# Altium schematic sheet transmitter.SchDoc (continued)
## Nets
5V: J1.5(5V) J1.6(3V3) J2.5(5V) J2.6(3V3) J3.5(5V) J3.6(3V3) J4.5(5V) J4.6(3V3) J5.5(5V) J5.6(3V3) J6.5(5V) J6.6(3V3) J7.5(5V) J7.6(3V3) J8.5(5V) J8.6(3V3)
GND: C1.1 C2.1 C3.1 C4.1 C5.1 C6.1 C7.1 C8.1 J1.3(GND) J1.4(GND) J1.97(GND) J1.98(GND) J2.3(GND) J2.4(GND) J2.97(GND) J2.98(GND) J3.3(GND) J3.4(GND) J3.97(GND) J3.98(GND) J4.3(GND) J4.4(GND) J4.97(GND) J4.98(GND) J5.3(GND) J5.4(GND) J5.97(GND) J5.98(GND) J6.3(GND) J6.4(GND) J6.97(GND) J6.98(GND) J7.3(GND) J7.4(GND) J7.97(GND) J7.98(GND) J8.3(GND) J8.4(GND) J8.97(GND) J8.98(GND)
VUS: C1.2 C2.2 C3.2 C4.2 C5.2 C6.2 C7.2 C8.2 J1.1(VUS) J1.2(VUS) J1.99(VUS) J1.100(VUS) J2.1(VUS) J2.2(VUS) J2.99(VUS) J2.100(VUS) J3.1(VUS) J3.2(VUS) J3.99(VUS) J3.100(VUS) J4.1(VUS) J4.2(VUS) J4.99(VUS) J4.100(VUS) J5.1(VUS) J5.2(VUS) J5.99(VUS) J5.100(VUS) J6.1(VUS) J6.2(VUS) J6.99(VUS) J6.100(VUS) J7.1(VUS) J7.2(VUS) J7.99(VUS) J7.100(VUS) J8.1(VUS) J8.2(VUS) J8.99(VUS) J8.100(VUS)
NetJ1_7: J1.7(US_N) ; sheet U_ultra/US_N
NetJ1_8: J1.8(US_P) ; sheet U_ultra/US_P
NetJ1_9: J1.9(US_N) ; sheet U_ultra/US_N
NetJ1_10: J1.10(US_P) ; sheet U_ultra/US_P
NetJ1_11: J1.11(US_N) ; sheet U_ultra/US_N
NetJ1_12: J1.12(US_P) ; sheet U_ultra/US_P
NetJ1_13: J1.13(US_N) ; sheet U_ultra/US_N
NetJ1_14: J1.14(US_P) ; sheet U_ultra/US_P
NetJ1_15: J1.15(US_N) ; sheet U_ultra/US_N
NetJ1_16: J1.16(US_P) ; sheet U_ultra/US_P
NetJ1_17: J1.17(US_N) ; sheet U_ultra/US_N
NetJ1_18: J1.18(US_P) ; sheet U_ultra/US_P
NetJ1_19: J1.19(US_N) ; sheet U_ultra/US_N
NetJ1_20: J1.20(US_P) ; sheet U_ultra/US_P
NetJ1_21: J1.21(US_N) ; sheet U_ultra/US_N
NetJ1_22: J1.22(US_P) ; sheet U_ultra/US_P
NetJ1_23: J1.23(US_N) ; sheet U_ultra/US_N
NetJ1_24: J1.24(US_P) ; sheet U_ultra/US_P
NetJ1_25: J1.25(US_N) ; sheet U_ultra/US_N
NetJ1_26: J1.26(US_P) ; sheet U_ultra/US_P
NetJ1_27: J1.27(US_N) ; sheet U_ultra/US_N
NetJ1_28: J1.28(US_P) ; sheet U_ultra/US_P
NetJ1_29: J1.29(US_N) ; sheet U_ultra/US_N
NetJ1_30: J1.30(US_P) ; sheet U_ultra/US_P
NetJ1_31: J1.31(US_N) ; sheet U_ultra/US_N
NetJ1_32: J1.32(US_P) ; sheet U_ultra/US_P
NetJ1_33: J1.33(US_N) ; sheet U_ultra/US_N
NetJ1_34: J1.34(US_P) ; sheet U_ultra/US_P
NetJ1_35: J1.35(US_N) ; sheet U_ultra/US_N
NetJ1_36: J1.36(US_P) ; sheet U_ultra/US_P
NetJ1_37: J1.37(US_N) ; sheet U_ultra/US_N
NetJ1_38: J1.38(US_P) ; sheet U_ultra/US_P
NetJ1_39: J1.39(US_N) ; sheet U_ultra/US_N
NetJ1_40: J1.40(US_P) ; sheet U_ultra/US_P
NetJ1_41: J1.41(US_N) ; sheet U_ultra/US_N
NetJ1_42: J1.42(US_P) ; sheet U_ultra/US_P
NetJ1_43: J1.43(US_N) ; sheet U_ultra/US_N
NetJ1_44: J1.44(US_P) ; sheet U_ultra/US_P
NetJ1_45: J1.45(US_N) ; sheet U_ultra/US_N
NetJ1_46: J1.46(US_P) ; sheet U_ultra/US_P
NetJ1_47: J1.47(US_N) ; sheet U_ultra/US_N
NetJ1_48: J1.48(US_P) ; sheet U_ultra/US_P
NetJ1_49: J1.49(US_N) ; sheet U_ultra/US_N
NetJ1_50: J1.50(US_P) ; sheet U_ultra/US_P
NetJ1_51: J1.51(US_N) ; sheet U_ultra/US_N
NetJ1_52: J1.52(US_P) ; sheet U_ultra/US_P
NetJ1_53: J1.53(US_N) ; sheet U_ultra/US_N
NetJ1_54: J1.54(US_P) ; sheet U_ultra/US_P
NetJ1_55: J1.55(US_N) ; sheet U_ultra/US_N
NetJ1_56: J1.56(US_P) ; sheet U_ultra/US_P
NetJ1_57: J1.57(US_N) ; sheet U_ultra/US_N
NetJ1_58: J1.58(US_P) ; sheet U_ultra/US_P
NetJ1_59: J1.59(US_N) ; sheet U_ultra/US_N
NetJ1_60: J1.60(US_P) ; sheet U_ultra/US_P
NetJ1_61: J1.61(US_N) ; sheet U_ultra/US_N
NetJ1_62: J1.62(US_P) ; sheet U_ultra/US_P
NetJ1_63: J1.63(US_N) ; sheet U_ultra/US_N
NetJ1_64: J1.64(US_P) ; sheet U_ultra/US_P
NetJ1_65: J1.65(US_N) ; sheet U_ultra/US_N
NetJ1_66: J1.66(US_P) ; sheet U_ultra/US_P
NetJ1_67: J1.67(US_N) ; sheet U_ultra/US_N
NetJ1_68: J1.68(US_P) ; sheet U_ultra/US_P
NetJ1_69: J1.69(US_N) ; sheet U_ultra/US_N
NetJ1_70: J1.70(US_P) ; sheet U_ultra/US_P
NetJ1_71: J1.71(US_N) ; sheet U_ultra/US_N
NetJ1_72: J1.72(US_P) ; sheet U_ultra/US_P
NetJ1_73: J1.73(US_N) ; sheet U_ultra/US_N
NetJ1_74: J1.74(US_P) ; sheet U_ultra/US_P
NetJ1_75: J1.75(US_N) ; sheet U_ultra/US_N
NetJ1_76: J1.76(US_P) ; sheet U_ultra/US_P
NetJ1_77: J1.77(US_N) ; sheet U_ultra/US_N
NetJ1_78: J1.78(US_P) ; sheet U_ultra/US_P
NetJ1_79: J1.79(US_N) ; sheet U_ultra/US_N
NetJ1_80: J1.80(US_P) ; sheet U_ultra/US_P
NetJ1_81: J1.81(US_N) ; sheet U_ultra/US_N
NetJ1_82: J1.82(US_P) ; sheet U_ultra/US_P
NetJ1_83: J1.83(US_N) ; sheet U_ultra/US_N
NetJ1_84: J1.84(US_P) ; sheet U_ultra/US_P
NetJ1_85: J1.85(US_N) ; sheet U_ultra/US_N
NetJ1_86: J1.86(US_P) ; sheet U_ultra/US_P
NetJ1_87: J1.87(US_N) ; sheet U_ultra/US_N
NetJ1_88: J1.88(US_P) ; sheet U_ultra/US_P
NetJ1_89: J1.89(US_N) ; sheet U_ultra/US_N
NetJ1_90: J1.90(US_P) ; sheet U_ultra/US_P
NetJ1_91: J1.91(US_N) ; sheet U_ultra/US_N
NetJ1_92: J1.92(US_P) ; sheet U_ultra/US_P
NetJ1_93: J1.93(US_N) ; sheet U_ultra/US_N
NetJ1_94: J1.94(US_P) ; sheet U_ultra/US_P
NetJ1_95: J1.95(US_N) ; sheet U_ultra/US_N
NetJ1_96: J1.96(US_P) ; sheet U_ultra/US_P
NetJ2_7: J2.7(US_N) ; sheet U_ultra/US_N
NetJ2_8: J2.8(US_P) ; sheet U_ultra/US_P
NetJ2_9: J2.9(US_N) ; sheet U_ultra/US_N
NetJ2_10: J2.10(US_P) ; sheet U_ultra/US_P
NetJ2_11: J2.11(US_N) ; sheet U_ultra/US_N
NetJ2_12: J2.12(US_P) ; sheet U_ultra/US_P
NetJ2_13: J2.13(US_N) ; sheet U_ultra/US_N
NetJ2_14: J2.14(US_P) ; sheet U_ultra/US_P
NetJ2_15: J2.15(US_N) ; sheet U_ultra/US_N
NetJ2_16: J2.16(US_P) ; sheet U_ultra/US_P
NetJ2_17: J2.17(US_N) ; sheet U_ultra/US_N
NetJ2_18: J2.18(US_P) ; sheet U_ultra/US_P
NetJ2_19: J2.19(US_N) ; sheet U_ultra/US_N
NetJ2_20: J2.20(US_P) ; sheet U_ultra/US_P
NetJ2_21: J2.21(US_N) ; sheet U_ultra/US_N
NetJ2_22: J2.22(US_P) ; sheet U_ultra/US_P
NetJ2_23: J2.23(US_N) ; sheet U_ultra/US_N
NetJ2_24: J2.24(US_P) ; sheet U_ultra/US_P
NetJ2_25: J2.25(US_N) ; sheet U_ultra/US_N
NetJ2_26: J2.26(US_P) ; sheet U_ultra/US_P
NetJ2_27: J2.27(US_N) ; sheet U_ultra/US_N
NetJ2_28: J2.28(US_P) ; sheet U_ultra/US_P
NetJ2_29: J2.29(US_N) ; sheet U_ultra/US_N
NetJ2_30: J2.30(US_P) ; sheet U_ultra/US_P
NetJ2_31: J2.31(US_N) ; sheet U_ultra/US_N
NetJ2_32: J2.32(US_P) ; sheet U_ultra/US_P
NetJ2_33: J2.33(US_N) ; sheet U_ultra/US_N
NetJ2_34: J2.34(US_P) ; sheet U_ultra/US_P
NetJ2_35: J2.35(US_N) ; sheet U_ultra/US_N
NetJ2_36: J2.36(US_P) ; sheet U_ultra/US_P
NetJ2_37: J2.37(US_N) ; sheet U_ultra/US_N
NetJ2_38: J2.38(US_P) ; sheet U_ultra/US_P
NetJ2_39: J2.39(US_N) ; sheet U_ultra/US_N
NetJ2_40: J2.40(US_P) ; sheet U_ultra/US_P
NetJ2_41: J2.41(US_N) ; sheet U_ultra/US_N
NetJ2_42: J2.42(US_P) ; sheet U_ultra/US_P
NetJ2_43: J2.43(US_N) ; sheet U_ultra/US_N
NetJ2_44: J2.44(US_P) ; sheet U_ultra/US_P
NetJ2_45: J2.45(US_N) ; sheet U_ultra/US_N
NetJ2_46: J2.46(US_P) ; sheet U_ultra/US_P
NetJ2_47: J2.47(US_N) ; sheet U_ultra/US_N
NetJ2_48: J2.48(US_P) ; sheet U_ultra/US_P
NetJ2_49: J2.49(US_N) ; sheet U_ultra/US_N
NetJ2_50: J2.50(US_P) ; sheet U_ultra/US_P
NetJ2_51: J2.51(US_N) ; sheet U_ultra/US_N
NetJ2_52: J2.52(US_P) ; sheet U_ultra/US_P
NetJ2_53: J2.53(US_N) ; sheet U_ultra/US_N
NetJ2_54: J2.54(US_P) ; sheet U_ultra/US_P
NetJ2_55: J2.55(US_N) ; sheet U_ultra/US_N
NetJ2_56: J2.56(US_P) ; sheet U_ultra/US_P
NetJ2_57: J2.57(US_N) ; sheet U_ultra/US_N
NetJ2_58: J2.58(US_P) ; sheet U_ultra/US_P
NetJ2_59: J2.59(US_N) ; sheet U_ultra/US_N
NetJ2_60: J2.60(US_P) ; sheet U_ultra/US_P
NetJ2_61: J2.61(US_N) ; sheet U_ultra/US_N
NetJ2_62: J2.62(US_P) ; sheet U_ultra/US_P
NetJ2_63: J2.63(US_N) ; sheet U_ultra/US_N
NetJ2_64: J2.64(US_P) ; sheet U_ultra/US_P
NetJ2_65: J2.65(US_N) ; sheet U_ultra/US_N
NetJ2_66: J2.66(US_P) ; sheet U_ultra/US_P
NetJ2_67: J2.67(US_N) ; sheet U_ultra/US_N
NetJ2_68: J2.68(US_P) ; sheet U_ultra/US_P
NetJ2_69: J2.69(US_N) ; sheet U_ultra/US_N
NetJ2_70: J2.70(US_P) ; sheet U_ultra/US_P
NetJ2_71: J2.71(US_N) ; sheet U_ultra/US_N
NetJ2_72: J2.72(US_P) ; sheet U_ultra/US_P
NetJ2_73: J2.73(US_N) ; sheet U_ultra/US_N
NetJ2_74: J2.74(US_P) ; sheet U_ultra/US_P
NetJ2_75: J2.75(US_N) ; sheet U_ultra/US_N
NetJ2_76: J2.76(US_P) ; sheet U_ultra/US_P
NetJ2_77: J2.77(US_N) ; sheet U_ultra/US_N
NetJ2_78: J2.78(US_P) ; sheet U_ultra/US_P
NetJ2_79: J2.79(US_N) ; sheet U_ultra/US_N
NetJ2_80: J2.80(US_P) ; sheet U_ultra/US_P
NetJ2_81: J2.81(US_N) ; sheet U_ultra/US_N
NetJ2_82: J2.82(US_P) ; sheet U_ultra/US_P
NetJ2_83: J2.83(US_N) ; sheet U_ultra/US_N
NetJ2_84: J2.84(US_P) ; sheet U_ultra/US_P
NetJ2_85: J2.85(US_N) ; sheet U_ultra/US_N
NetJ2_86: J2.86(US_P) ; sheet U_ultra/US_P
NetJ2_87: J2.87(US_N) ; sheet U_ultra/US_N
NetJ2_88: J2.88(US_P) ; sheet U_ultra/US_P
NetJ2_89: J2.89(US_N) ; sheet U_ultra/US_N
NetJ2_90: J2.90(US_P) ; sheet U_ultra/US_P
NetJ2_91: J2.91(US_N) ; sheet U_ultra/US_N
NetJ2_92: J2.92(US_P) ; sheet U_ultra/US_P
NetJ2_93: J2.93(US_N) ; sheet U_ultra/US_N
NetJ2_94: J2.94(US_P) ; sheet U_ultra/US_P
NetJ2_95: J2.95(US_N) ; sheet U_ultra/US_N
NetJ2_96: J2.96(US_P) ; sheet U_ultra/US_P
NetJ3_7: J3.7(US_N) ; sheet U_ultra/US_N
NetJ3_8: J3.8(US_P) ; sheet U_ultra/US_P
NetJ3_9: J3.9(US_N) ; sheet U_ultra/US_N
NetJ3_10: J3.10(US_P) ; sheet U_ultra/US_P
NetJ3_11: J3.11(US_N) ; sheet U_ultra/US_N
NetJ3_12: J3.12(US_P) ; sheet U_ultra/US_P
NetJ3_13: J3.13(US_N) ; sheet U_ultra/US_N
NetJ3_14: J3.14(US_P) ; sheet U_ultra/US_P
NetJ3_15: J3.15(US_N) ; sheet U_ultra/US_N
NetJ3_16: J3.16(US_P) ; sheet U_ultra/US_P
NetJ3_17: J3.17(US_N) ; sheet U_ultra/US_N
NetJ3_18: J3.18(US_P) ; sheet U_ultra/US_P
NetJ3_19: J3.19(US_N) ; sheet U_ultra/US_N
NetJ3_20: J3.20(US_P) ; sheet U_ultra/US_P
NetJ3_21: J3.21(US_N) ; sheet U_ultra/US_N
NetJ3_22: J3.22(US_P) ; sheet U_ultra/US_P
NetJ3_23: J3.23(US_N) ; sheet U_ultra/US_N
NetJ3_24: J3.24(US_P) ; sheet U_ultra/US_P
NetJ3_25: J3.25(US_N) ; sheet U_ultra/US_N
NetJ3_26: J3.26(US_P) ; sheet U_ultra/US_P
NetJ3_27: J3.27(US_N) ; sheet U_ultra/US_N
NetJ3_28: J3.28(US_P) ; sheet U_ultra/US_P
NetJ3_29: J3.29(US_N) ; sheet U_ultra/US_N
NetJ3_30: J3.30(US_P) ; sheet U_ultra/US_P
NetJ3_31: J3.31(US_N) ; sheet U_ultra/US_N
NetJ3_32: J3.32(US_P) ; sheet U_ultra/US_P
NetJ3_33: J3.33(US_N) ; sheet U_ultra/US_N
NetJ3_34: J3.34(US_P) ; sheet U_ultra/US_P
NetJ3_35: J3.35(US_N) ; sheet U_ultra/US_N
NetJ3_36: J3.36(US_P) ; sheet U_ultra/US_P
NetJ3_37: J3.37(US_N) ; sheet U_ultra/US_N
NetJ3_38: J3.38(US_P) ; sheet U_ultra/US_P
NetJ3_39: J3.39(US_N) ; sheet U_ultra/US_N
NetJ3_40: J3.40(US_P) ; sheet U_ultra/US_P
NetJ3_41: J3.41(US_N) ; sheet U_ultra/US_N
NetJ3_42: J3.42(US_P) ; sheet U_ultra/US_P
NetJ3_43: J3.43(US_N) ; sheet U_ultra/US_N
NetJ3_44: J3.44(US_P) ; sheet U_ultra/US_P
NetJ3_45: J3.45(US_N) ; sheet U_ultra/US_N
NetJ3_46: J3.46(US_P) ; sheet U_ultra/US_P
NetJ3_47: J3.47(US_N) ; sheet U_ultra/US_N
NetJ3_48: J3.48(US_P) ; sheet U_ultra/US_P
NetJ3_49: J3.49(US_N) ; sheet U_ultra/US_N
NetJ3_50: J3.50(US_P) ; sheet U_ultra/US_P
NetJ3_51: J3.51(US_N) ; sheet U_ultra/US_N
NetJ3_52: J3.52(US_P) ; sheet U_ultra/US_P
NetJ3_53: J3.53(US_N) ; sheet U_ultra/US_N
NetJ3_54: J3.54(US_P) ; sheet U_ultra/US_P
NetJ3_55: J3.55(US_N) ; sheet U_ultra/US_N
NetJ3_56: J3.56(US_P) ; sheet U_ultra/US_P
NetJ3_57: J3.57(US_N) ; sheet U_ultra/US_N
NetJ3_58: J3.58(US_P) ; sheet U_ultra/US_P
NetJ3_59: J3.59(US_N) ; sheet U_ultra/US_N
NetJ3_60: J3.60(US_P) ; sheet U_ultra/US_P
NetJ3_61: J3.61(US_N) ; sheet U_ultra/US_N
NetJ3_62: J3.62(US_P) ; sheet U_ultra/US_P
NetJ3_63: J3.63(US_N) ; sheet U_ultra/US_N
NetJ3_64: J3.64(US_P) ; sheet U_ultra/US_P
NetJ3_65: J3.65(US_N) ; sheet U_ultra/US_N
NetJ3_66: J3.66(US_P) ; sheet U_ultra/US_P
NetJ3_67: J3.67(US_N) ; sheet U_ultra/US_N
NetJ3_68: J3.68(US_P) ; sheet U_ultra/US_P
NetJ3_69: J3.69(US_N) ; sheet U_ultra/US_N
NetJ3_70: J3.70(US_P) ; sheet U_ultra/US_P
NetJ3_71: J3.71(US_N) ; sheet U_ultra/US_N
NetJ3_72: J3.72(US_P) ; sheet U_ultra/US_P
NetJ3_73: J3.73(US_N) ; sheet U_ultra/US_N
NetJ3_74: J3.74(US_P) ; sheet U_ultra/US_P
NetJ3_75: J3.75(US_N) ; sheet U_ultra/US_N
NetJ3_76: J3.76(US_P) ; sheet U_ultra/US_P
NetJ3_77: J3.77(US_N) ; sheet U_ultra/US_N
NetJ3_78: J3.78(US_P) ; sheet U_ultra/US_P
NetJ3_79: J3.79(US_N) ; sheet U_ultra/US_N
NetJ3_80: J3.80(US_P) ; sheet U_ultra/US_P
NetJ3_81: J3.81(US_N) ; sheet U_ultra/US_N
NetJ3_82: J3.82(US_P) ; sheet U_ultra/US_P
NetJ3_83: J3.83(US_N) ; sheet U_ultra/US_N
NetJ3_84: J3.84(US_P) ; sheet U_ultra/US_P
NetJ3_85: J3.85(US_N) ; sheet U_ultra/US_N
NetJ3_86: J3.86(US_P) ; sheet U_ultra/US_P
NetJ3_87: J3.87(US_N) ; sheet U_ultra/US_N
NetJ3_88: J3.88(US_P) ; sheet U_ultra/US_P
NetJ3_89: J3.89(US_N) ; sheet U_ultra/US_N
NetJ3_90: J3.90(US_P) ; sheet U_ultra/US_P
NetJ3_91: J3.91(US_N) ; sheet U_ultra/US_N
NetJ3_92: J3.92(US_P) ; sheet U_ultra/US_P
NetJ3_93: J3.93(US_N) ; sheet U_ultra/US_N
NetJ3_94: J3.94(US_P) ; sheet U_ultra/US_P
NetJ3_95: J3.95(US_N) ; sheet U_ultra/US_N
NetJ3_96: J3.96(US_P) ; sheet U_ultra/US_P
NetJ4_7: J4.7(US_N) ; sheet U_ultra/US_N
NetJ4_8: J4.8(US_P) ; sheet U_ultra/US_P
NetJ4_9: J4.9(US_N) ; sheet U_ultra/US_N
NetJ4_10: J4.10(US_P) ; sheet U_ultra/US_P
NetJ4_11: J4.11(US_N) ; sheet U_ultra/US_N
NetJ4_12: J4.12(US_P) ; sheet U_ultra/US_P
NetJ4_13: J4.13(US_N) ; sheet U_ultra/US_N
NetJ4_14: J4.14(US_P) ; sheet U_ultra/US_P
NetJ4_15: J4.15(US_N) ; sheet U_ultra/US_N
NetJ4_16: J4.16(US_P) ; sheet U_ultra/US_P
NetJ4_17: J4.17(US_N) ; sheet U_ultra/US_N
NetJ4_18: J4.18(US_P) ; sheet U_ultra/US_P
NetJ4_19: J4.19(US_N) ; sheet U_ultra/US_N
NetJ4_20: J4.20(US_P) ; sheet U_ultra/US_P
NetJ4_21: J4.21(US_N) ; sheet U_ultra/US_N
NetJ4_22: J4.22(US_P) ; sheet U_ultra/US_P
NetJ4_23: J4.23(US_N) ; sheet U_ultra/US_N
NetJ4_24: J4.24(US_P) ; sheet U_ultra/US_P
NetJ4_25: J4.25(US_N) ; sheet U_ultra/US_N
NetJ4_26: J4.26(US_P) ; sheet U_ultra/US_P
NetJ4_27: J4.27(US_N) ; sheet U_ultra/US_N
NetJ4_28: J4.28(US_P) ; sheet U_ultra/US_P
NetJ4_29: J4.29(US_N) ; sheet U_ultra/US_N
NetJ4_30: J4.30(US_P) ; sheet U_ultra/US_P
NetJ4_31: J4.31(US_N) ; sheet U_ultra/US_N
NetJ4_32: J4.32(US_P) ; sheet U_ultra/US_P
NetJ4_33: J4.33(US_N) ; sheet U_ultra/US_N
NetJ4_34: J4.34(US_P) ; sheet U_ultra/US_P
NetJ4_35: J4.35(US_N) ; sheet U_ultra/US_N
NetJ4_36: J4.36(US_P) ; sheet U_ultra/US_P
NetJ4_37: J4.37(US_N) ; sheet U_ultra/US_N
NetJ4_38: J4.38(US_P) ; sheet U_ultra/US_P
NetJ4_39: J4.39(US_N) ; sheet U_ultra/US_N
NetJ4_40: J4.40(US_P) ; sheet U_ultra/US_P
NetJ4_41: J4.41(US_N) ; sheet U_ultra/US_N
NetJ4_42: J4.42(US_P) ; sheet U_ultra/US_P
NetJ4_43: J4.43(US_N) ; sheet U_ultra/US_N
NetJ4_44: J4.44(US_P) ; sheet U_ultra/US_P
NetJ4_45: J4.45(US_N) ; sheet U_ultra/US_N
NetJ4_46: J4.46(US_P) ; sheet U_ultra/US_P
NetJ4_47: J4.47(US_N) ; sheet U_ultra/US_N
NetJ4_48: J4.48(US_P) ; sheet U_ultra/US_P
NetJ4_49: J4.49(US_N) ; sheet U_ultra/US_N
NetJ4_50: J4.50(US_P) ; sheet U_ultra/US_P
NetJ4_51: J4.51(US_N) ; sheet U_ultra/US_N
NetJ4_52: J4.52(US_P) ; sheet U_ultra/US_P
NetJ4_53: J4.53(US_N) ; sheet U_ultra/US_N
NetJ4_54: J4.54(US_P) ; sheet U_ultra/US_P
NetJ4_55: J4.55(US_N) ; sheet U_ultra/US_N
NetJ4_56: J4.56(US_P) ; sheet U_ultra/US_P
NetJ4_57: J4.57(US_N) ; sheet U_ultra/US_N
NetJ4_58: J4.58(US_P) ; sheet U_ultra/US_P
NetJ4_59: J4.59(US_N) ; sheet U_ultra/US_N
NetJ4_60: J4.60(US_P) ; sheet U_ultra/US_P
NetJ4_61: J4.61(US_N) ; sheet U_ultra/US_N
NetJ4_62: J4.62(US_P) ; sheet U_ultra/US_P
NetJ4_63: J4.63(US_N) ; sheet U_ultra/US_N
NetJ4_64: J4.64(US_P) ; sheet U_ultra/US_P
NetJ4_65: J4.65(US_N) ; sheet U_ultra/US_N
NetJ4_66: J4.66(US_P) ; sheet U_ultra/US_P
NetJ4_67: J4.67(US_N) ; sheet U_ultra/US_N
NetJ4_68: J4.68(US_P) ; sheet U_ultra/US_P
NetJ4_69: J4.69(US_N) ; sheet U_ultra/US_N
NetJ4_70: J4.70(US_P) ; sheet U_ultra/US_P
NetJ4_71: J4.71(US_N) ; sheet U_ultra/US_N
NetJ4_72: J4.72(US_P) ; sheet U_ultra/US_P
NetJ4_73: J4.73(US_N) ; sheet U_ultra/US_N
NetJ4_74: J4.74(US_P) ; sheet U_ultra/US_P
NetJ4_75: J4.75(US_N) ; sheet U_ultra/US_N
NetJ4_76: J4.76(US_P) ; sheet U_ultra/US_P
NetJ4_77: J4.77(US_N) ; sheet U_ultra/US_N
NetJ4_78: J4.78(US_P) ; sheet U_ultra/US_P
NetJ4_79: J4.79(US_N) ; sheet U_ultra/US_N
NetJ4_80: J4.80(US_P) ; sheet U_ultra/US_P
NetJ4_81: J4.81(US_N) ; sheet U_ultra/US_N
NetJ4_82: J4.82(US_P) ; sheet U_ultra/US_P
NetJ4_83: J4.83(US_N) ; sheet U_ultra/US_N
NetJ4_84: J4.84(US_P) ; sheet U_ultra/US_P
NetJ4_85: J4.85(US_N) ; sheet U_ultra/US_N
NetJ4_86: J4.86(US_P) ; sheet U_ultra/US_P
NetJ4_87: J4.87(US_N) ; sheet U_ultra/US_N
NetJ4_88: J4.88(US_P) ; sheet U_ultra/US_P
NetJ4_89: J4.89(US_N) ; sheet U_ultra/US_N
NetJ4_90: J4.90(US_P) ; sheet U_ultra/US_P
NetJ4_91: J4.91(US_N) ; sheet U_ultra/US_N
NetJ4_92: J4.92(US_P) ; sheet U_ultra/US_P
NetJ4_93: J4.93(US_N) ; sheet U_ultra/US_N
NetJ4_94: J4.94(US_P) ; sheet U_ultra/US_P
NetJ4_95: J4.95(US_N) ; sheet U_ultra/US_N
NetJ4_96: J4.96(US_P) ; sheet U_ultra/US_P
NetJ5_7: J5.7(US_N) ; sheet U_ultra/US_N
NetJ5_8: J5.8(US_P) ; sheet U_ultra/US_P
NetJ5_9: J5.9(US_N) ; sheet U_ultra/US_N
NetJ5_10: J5.10(US_P) ; sheet U_ultra/US_P
NetJ5_11: J5.11(US_N) ; sheet U_ultra/US_N
NetJ5_12: J5.12(US_P) ; sheet U_ultra/US_P
NetJ5_13: J5.13(US_N) ; sheet U_ultra/US_N
NetJ5_14: J5.14(US_P) ; sheet U_ultra/US_P
NetJ5_15: J5.15(US_N) ; sheet U_ultra/US_N
NetJ5_16: J5.16(US_P) ; sheet U_ultra/US_P
NetJ5_17: J5.17(US_N) ; sheet U_ultra/US_N
NetJ5_18: J5.18(US_P) ; sheet U_ultra/US_P
NetJ5_19: J5.19(US_N) ; sheet U_ultra/US_N
NetJ5_20: J5.20(US_P) ; sheet U_ultra/US_P
NetJ5_21: J5.21(US_N) ; sheet U_ultra/US_N
NetJ5_22: J5.22(US_P) ; sheet U_ultra/US_P
NetJ5_23: J5.23(US_N) ; sheet U_ultra/US_N
NetJ5_24: J5.24(US_P) ; sheet U_ultra/US_P
NetJ5_25: J5.25(US_N) ; sheet U_ultra/US_N
NetJ5_26: J5.26(US_P) ; sheet U_ultra/US_P
NetJ5_27: J5.27(US_N) ; sheet U_ultra/US_N
NetJ5_28: J5.28(US_P) ; sheet U_ultra/US_P
NetJ5_29: J5.29(US_N) ; sheet U_ultra/US_N
NetJ5_30: J5.30(US_P) ; sheet U_ultra/US_P
NetJ5_31: J5.31(US_N) ; sheet U_ultra/US_N
NetJ5_32: J5.32(US_P) ; sheet U_ultra/US_P
NetJ5_33: J5.33(US_N) ; sheet U_ultra/US_N
NetJ5_34: J5.34(US_P) ; sheet U_ultra/US_P
NetJ5_35: J5.35(US_N) ; sheet U_ultra/US_N
NetJ5_36: J5.36(US_P) ; sheet U_ultra/US_P
NetJ5_37: J5.37(US_N) ; sheet U_ultra/US_N
NetJ5_38: J5.38(US_P) ; sheet U_ultra/US_P
NetJ5_39: J5.39(US_N) ; sheet U_ultra/US_N
NetJ5_40: J5.40(US_P) ; sheet U_ultra/US_P
NetJ5_41: J5.41(US_N) ; sheet U_ultra/US_N
NetJ5_42: J5.42(US_P) ; sheet U_ultra/US_P
NetJ5_43: J5.43(US_N) ; sheet U_ultra/US_N
NetJ5_44: J5.44(US_P) ; sheet U_ultra/US_P
NetJ5_45: J5.45(US_N) ; sheet U_ultra/US_N
NetJ5_46: J5.46(US_P) ; sheet U_ultra/US_P
NetJ5_47: J5.47(US_N) ; sheet U_ultra/US_N
NetJ5_48: J5.48(US_P) ; sheet U_ultra/US_P
NetJ5_49: J5.49(US_N) ; sheet U_ultra/US_N
NetJ5_50: J5.50(US_P) ; sheet U_ultra/US_P
NetJ5_51: J5.51(US_N) ; sheet U_ultra/US_N
NetJ5_52: J5.52(US_P) ; sheet U_ultra/US_P
NetJ5_53: J5.53(US_N) ; sheet U_ultra/US_N
NetJ5_54: J5.54(US_P) ; sheet U_ultra/US_P
NetJ5_55: J5.55(US_N) ; sheet U_ultra/US_N
NetJ5_56: J5.56(US_P) ; sheet U_ultra/US_P
NetJ5_57: J5.57(US_N) ; sheet U_ultra/US_N
NetJ5_58: J5.58(US_P) ; sheet U_ultra/US_P
NetJ5_59: J5.59(US_N) ; sheet U_ultra/US_N
NetJ5_60: J5.60(US_P) ; sheet U_ultra/US_P
NetJ5_61: J5.61(US_N) ; sheet U_ultra/US_N
NetJ5_62: J5.62(US_P) ; sheet U_ultra/US_P
NetJ5_63: J5.63(US_N) ; sheet U_ultra/US_N
NetJ5_64: J5.64(US_P) ; sheet U_ultra/US_P
NetJ5_65: J5.65(US_N) ; sheet U_ultra/US_N
NetJ5_66: J5.66(US_P) ; sheet U_ultra/US_P
NetJ5_67: J5.67(US_N) ; sheet U_ultra/US_N
NetJ5_68: J5.68(US_P) ; sheet U_ultra/US_P
NetJ5_69: J5.69(US_N) ; sheet U_ultra/US_N
NetJ5_70: J5.70(US_P) ; sheet U_ultra/US_P
NetJ5_71: J5.71(US_N) ; sheet U_ultra/US_N
NetJ5_72: J5.72(US_P) ; sheet U_ultra/US_P
NetJ5_73: J5.73(US_N) ; sheet U_ultra/US_N
NetJ5_74: J5.74(US_P) ; sheet U_ultra/US_P
NetJ5_75: J5.75(US_N) ; sheet U_ultra/US_N
NetJ5_76: J5.76(US_P) ; sheet U_ultra/US_P
NetJ5_77: J5.77(US_N) ; sheet U_ultra/US_N
NetJ5_78: J5.78(US_P) ; sheet U_ultra/US_P
NetJ5_79: J5.79(US_N) ; sheet U_ultra/US_N
NetJ5_80: J5.80(US_P) ; sheet U_ultra/US_P
NetJ5_81: J5.81(US_N) ; sheet U_ultra/US_N
NetJ5_82: J5.82(US_P) ; sheet U_ultra/US_P
NetJ5_83: J5.83(US_N) ; sheet U_ultra/US_N
NetJ5_84: J5.84(US_P) ; sheet U_ultra/US_P
NetJ5_85: J5.85(US_N) ; sheet U_ultra/US_N
NetJ5_86: J5.86(US_P) ; sheet U_ultra/US_P
NetJ5_87: J5.87(US_N) ; sheet U_ultra/US_N
NetJ5_88: J5.88(US_P) ; sheet U_ultra/US_P
NetJ5_89: J5.89(US_N) ; sheet U_ultra/US_N
NetJ5_90: J5.90(US_P) ; sheet U_ultra/US_P
NetJ5_91: J5.91(US_N) ; sheet U_ultra/US_N
NetJ5_92: J5.92(US_P) ; sheet U_ultra/US_P
NetJ5_93: J5.93(US_N) ; sheet U_ultra/US_N
NetJ5_94: J5.94(US_P) ; sheet U_ultra/US_P
NetJ5_95: J5.95(US_N) ; sheet U_ultra/US_N
NetJ5_96: J5.96(US_P) ; sheet U_ultra/US_P
NetJ6_7: J6.7(US_N) ; sheet U_ultra/US_N
NetJ6_8: J6.8(US_P) ; sheet U_ultra/US_P
NetJ6_9: J6.9(US_N) ; sheet U_ultra/US_N
NetJ6_10: J6.10(US_P) ; sheet U_ultra/US_P
NetJ6_11: J6.11(US_N) ; sheet U_ultra/US_N
NetJ6_12: J6.12(US_P) ; sheet U_ultra/US_P
NetJ6_13: J6.13(US_N) ; sheet U_ultra/US_N
NetJ6_14: J6.14(US_P) ; sheet U_ultra/US_P
NetJ6_15: J6.15(US_N) ; sheet U_ultra/US_N
NetJ6_16: J6.16(US_P) ; sheet U_ultra/US_P
NetJ6_17: J6.17(US_N) ; sheet U_ultra/US_N
NetJ6_18: J6.18(US_P) ; sheet U_ultra/US_P
NetJ6_19: J6.19(US_N) ; sheet U_ultra/US_N
NetJ6_20: J6.20(US_P) ; sheet U_ultra/US_P
NetJ6_21: J6.21(US_N) ; sheet U_ultra/US_N
NetJ6_22: J6.22(US_P) ; sheet U_ultra/US_P
NetJ6_23: J6.23(US_N) ; sheet U_ultra/US_N
NetJ6_24: J6.24(US_P) ; sheet U_ultra/US_P
NetJ6_25: J6.25(US_N) ; sheet U_ultra/US_N
NetJ6_26: J6.26(US_P) ; sheet U_ultra/US_P
NetJ6_27: J6.27(US_N) ; sheet U_ultra/US_N
NetJ6_28: J6.28(US_P) ; sheet U_ultra/US_P
NetJ6_29: J6.29(US_N) ; sheet U_ultra/US_N
NetJ6_30: J6.30(US_P) ; sheet U_ultra/US_P
NetJ6_31: J6.31(US_N) ; sheet U_ultra/US_N
NetJ6_32: J6.32(US_P) ; sheet U_ultra/US_P
NetJ6_33: J6.33(US_N) ; sheet U_ultra/US_N
NetJ6_34: J6.34(US_P) ; sheet U_ultra/US_P
NetJ6_35: J6.35(US_N) ; sheet U_ultra/US_N
NetJ6_36: J6.36(US_P) ; sheet U_ultra/US_P
NetJ6_37: J6.37(US_N) ; sheet U_ultra/US_N
NetJ6_38: J6.38(US_P) ; sheet U_ultra/US_P
NetJ6_39: J6.39(US_N) ; sheet U_ultra/US_N
NetJ6_40: J6.40(US_P) ; sheet U_ultra/US_P
NetJ6_41: J6.41(US_N) ; sheet U_ultra/US_N
NetJ6_42: J6.42(US_P) ; sheet U_ultra/US_P
NetJ6_43: J6.43(US_N) ; sheet U_ultra/US_N
NetJ6_44: J6.44(US_P) ; sheet U_ultra/US_P
NetJ6_45: J6.45(US_N) ; sheet U_ultra/US_N
NetJ6_46: J6.46(US_P) ; sheet U_ultra/US_P
NetJ6_47: J6.47(US_N) ; sheet U_ultra/US_N
NetJ6_48: J6.48(US_P) ; sheet U_ultra/US_P
NetJ6_49: J6.49(US_N) ; sheet U_ultra/US_N
NetJ6_50: J6.50(US_P) ; sheet U_ultra/US_P
NetJ6_51: J6.51(US_N) ; sheet U_ultra/US_N
NetJ6_52: J6.52(US_P) ; sheet U_ultra/US_P
NetJ6_53: J6.53(US_N) ; sheet U_ultra/US_N
NetJ6_54: J6.54(US_P) ; sheet U_ultra/US_P
NetJ6_55: J6.55(US_N) ; sheet U_ultra/US_N
NetJ6_56: J6.56(US_P) ; sheet U_ultra/US_P
NetJ6_57: J6.57(US_N) ; sheet U_ultra/US_N
NetJ6_58: J6.58(US_P) ; sheet U_ultra/US_P
NetJ6_59: J6.59(US_N) ; sheet U_ultra/US_N
NetJ6_60: J6.60(US_P) ; sheet U_ultra/US_P
NetJ6_61: J6.61(US_N) ; sheet U_ultra/US_N
NetJ6_62: J6.62(US_P) ; sheet U_ultra/US_P
NetJ6_63: J6.63(US_N) ; sheet U_ultra/US_N
NetJ6_64: J6.64(US_P) ; sheet U_ultra/US_P
NetJ6_65: J6.65(US_N) ; sheet U_ultra/US_N
NetJ6_66: J6.66(US_P) ; sheet U_ultra/US_P
NetJ6_67: J6.67(US_N) ; sheet U_ultra/US_N
NetJ6_68: J6.68(US_P) ; sheet U_ultra/US_P
NetJ6_69: J6.69(US_N) ; sheet U_ultra/US_N
NetJ6_70: J6.70(US_P) ; sheet U_ultra/US_P
NetJ6_71: J6.71(US_N) ; sheet U_ultra/US_N
NetJ6_72: J6.72(US_P) ; sheet U_ultra/US_P
NetJ6_73: J6.73(US_N) ; sheet U_ultra/US_N
NetJ6_74: J6.74(US_P) ; sheet U_ultra/US_P
NetJ6_75: J6.75(US_N) ; sheet U_ultra/US_N
NetJ6_76: J6.76(US_P) ; sheet U_ultra/US_P
NetJ6_77: J6.77(US_N) ; sheet U_ultra/US_N
NetJ6_78: J6.78(US_P) ; sheet U_ultra/US_P
NetJ6_79: J6.79(US_N) ; sheet U_ultra/US_N
NetJ6_80: J6.80(US_P) ; sheet U_ultra/US_P
NetJ6_81: J6.81(US_N) ; sheet U_ultra/US_N
NetJ6_82: J6.82(US_P) ; sheet U_ultra/US_P
NetJ6_83: J6.83(US_N) ; sheet U_ultra/US_N
NetJ6_84: J6.84(US_P) ; sheet U_ultra/US_P
NetJ6_85: J6.85(US_N) ; sheet U_ultra/US_N
NetJ6_86: J6.86(US_P) ; sheet U_ultra/US_P
NetJ6_87: J6.87(US_N) ; sheet U_ultra/US_N
NetJ6_88: J6.88(US_P) ; sheet U_ultra/US_P
NetJ6_89: J6.89(US_N) ; sheet U_ultra/US_N
NetJ6_90: J6.90(US_P) ; sheet U_ultra/US_P
NetJ6_91: J6.91(US_N) ; sheet U_ultra/US_N
NetJ6_92: J6.92(US_P) ; sheet U_ultra/US_P
NetJ6_93: J6.93(US_N) ; sheet U_ultra/US_N
NetJ6_94: J6.94(US_P) ; sheet U_ultra/US_P
NetJ6_95: J6.95(US_N) ; sheet U_ultra/US_N
NetJ6_96: J6.96(US_P) ; sheet U_ultra/US_P
NetJ7_7: J7.7(US_N) ; sheet U_ultra/US_N
NetJ7_8: J7.8(US_P) ; sheet U_ultra/US_P
NetJ7_9: J7.9(US_N) ; sheet U_ultra/US_N
NetJ7_10: J7.10(US_P) ; sheet U_ultra/US_P
NetJ7_11: J7.11(US_N) ; sheet U_ultra/US_N
NetJ7_12: J7.12(US_P) ; sheet U_ultra/US_P
NetJ7_13: J7.13(US_N) ; sheet U_ultra/US_N
NetJ7_14: J7.14(US_P) ; sheet U_ultra/US_P
NetJ7_15: J7.15(US_N) ; sheet U_ultra/US_N
NetJ7_16: J7.16(US_P) ; sheet U_ultra/US_P
NetJ7_17: J7.17(US_N) ; sheet U_ultra/US_N
NetJ7_18: J7.18(US_P) ; sheet U_ultra/US_P
NetJ7_19: J7.19(US_N) ; sheet U_ultra/US_N
NetJ7_20: J7.20(US_P) ; sheet U_ultra/US_P
NetJ7_21: J7.21(US_N) ; sheet U_ultra/US_N
NetJ7_22: J7.22(US_P) ; sheet U_ultra/US_P
NetJ7_23: J7.23(US_N) ; sheet U_ultra/US_N
NetJ7_24: J7.24(US_P) ; sheet U_ultra/US_P
NetJ7_25: J7.25(US_N) ; sheet U_ultra/US_N
NetJ7_26: J7.26(US_P) ; sheet U_ultra/US_P
NetJ7_27: J7.27(US_N) ; sheet U_ultra/US_N
NetJ7_28: J7.28(US_P) ; sheet U_ultra/US_P
NetJ7_29: J7.29(US_N) ; sheet U_ultra/US_N
NetJ7_30: J7.30(US_P) ; sheet U_ultra/US_P
NetJ7_31: J7.31(US_N) ; sheet U_ultra/US_N
NetJ7_32: J7.32(US_P) ; sheet U_ultra/US_P
NetJ7_33: J7.33(US_N) ; sheet U_ultra/US_N
NetJ7_34: J7.34(US_P) ; sheet U_ultra/US_P
NetJ7_35: J7.35(US_N) ; sheet U_ultra/US_N
NetJ7_36: J7.36(US_P) ; sheet U_ultra/US_P
NetJ7_37: J7.37(US_N) ; sheet U_ultra/US_N
NetJ7_38: J7.38(US_P) ; sheet U_ultra/US_P
NetJ7_39: J7.39(US_N) ; sheet U_ultra/US_N
NetJ7_40: J7.40(US_P) ; sheet U_ultra/US_P
NetJ7_41: J7.41(US_N) ; sheet U_ultra/US_N
NetJ7_42: J7.42(US_P) ; sheet U_ultra/US_P
NetJ7_43: J7.43(US_N) ; sheet U_ultra/US_N
NetJ7_44: J7.44(US_P) ; sheet U_ultra/US_P
NetJ7_45: J7.45(US_N) ; sheet U_ultra/US_N
NetJ7_46: J7.46(US_P) ; sheet U_ultra/US_P
NetJ7_47: J7.47(US_N) ; sheet U_ultra/US_N
NetJ7_48: J7.48(US_P) ; sheet U_ultra/US_P
NetJ7_49: J7.49(US_N) ; sheet U_ultra/US_N
NetJ7_50: J7.50(US_P) ; sheet U_ultra/US_P
NetJ7_51: J7.51(US_N) ; sheet U_ultra/US_N
NetJ7_52: J7.52(US_P) ; sheet U_ultra/US_P
NetJ7_53: J7.53(US_N) ; sheet U_ultra/US_N
NetJ7_54: J7.54(US_P) ; sheet U_ultra/US_P
NetJ7_55: J7.55(US_N) ; sheet U_ultra/US_N
NetJ7_56: J7.56(US_P) ; sheet U_ultra/US_P
NetJ7_57: J7.57(US_N) ; sheet U_ultra/US_N
NetJ7_58: J7.58(US_P) ; sheet U_ultra/US_P
NetJ7_59: J7.59(US_N) ; sheet U_ultra/US_N
NetJ7_60: J7.60(US_P) ; sheet U_ultra/US_P
NetJ7_61: J7.61(US_N) ; sheet U_ultra/US_N
NetJ7_62: J7.62(US_P) ; sheet U_ultra/US_P
NetJ7_63: J7.63(US_N) ; sheet U_ultra/US_N
NetJ7_64: J7.64(US_P) ; sheet U_ultra/US_P
NetJ7_65: J7.65(US_N) ; sheet U_ultra/US_N
NetJ7_66: J7.66(US_P) ; sheet U_ultra/US_P
NetJ7_67: J7.67(US_N) ; sheet U_ultra/US_N
NetJ7_68: J7.68(US_P) ; sheet U_ultra/US_P
NetJ7_69: J7.69(US_N) ; sheet U_ultra/US_N
NetJ7_70: J7.70(US_P) ; sheet U_ultra/US_P
NetJ7_71: J7.71(US_N) ; sheet U_ultra/US_N
NetJ7_72: J7.72(US_P) ; sheet U_ultra/US_P
NetJ7_73: J7.73(US_N) ; sheet U_ultra/US_N
NetJ7_74: J7.74(US_P) ; sheet U_ultra/US_P
NetJ7_75: J7.75(US_N) ; sheet U_ultra/US_N
NetJ7_76: J7.76(US_P) ; sheet U_ultra/US_P
NetJ7_77: J7.77(US_N) ; sheet U_ultra/US_N
NetJ7_78: J7.78(US_P) ; sheet U_ultra/US_P
NetJ7_79: J7.79(US_N) ; sheet U_ultra/US_N
NetJ7_80: J7.80(US_P) ; sheet U_ultra/US_P
NetJ7_81: J7.81(US_N) ; sheet U_ultra/US_N
NetJ7_82: J7.82(US_P) ; sheet U_ultra/US_P
NetJ7_83: J7.83(US_N) ; sheet U_ultra/US_N
NetJ7_84: J7.84(US_P) ; sheet U_ultra/US_P
NetJ7_85: J7.85(US_N) ; sheet U_ultra/US_N
NetJ7_86: J7.86(US_P) ; sheet U_ultra/US_P
NetJ7_87: J7.87(US_N) ; sheet U_ultra/US_N
NetJ7_88: J7.88(US_P) ; sheet U_ultra/US_P
NetJ7_89: J7.89(US_N) ; sheet U_ultra/US_N
NetJ7_90: J7.90(US_P) ; sheet U_ultra/US_P
NetJ7_91: J7.91(US_N) ; sheet U_ultra/US_N
NetJ7_92: J7.92(US_P) ; sheet U_ultra/US_P
NetJ7_93: J7.93(US_N) ; sheet U_ultra/US_N
NetJ7_94: J7.94(US_P) ; sheet U_ultra/US_P
NetJ7_95: J7.95(US_N) ; sheet U_ultra/US_N
NetJ7_96: J7.96(US_P) ; sheet U_ultra/US_P
NetJ8_7: J8.7(US_N) ; sheet U_ultra/US_N
NetJ8_8: J8.8(US_P) ; sheet U_ultra/US_P
NetJ8_9: J8.9(US_N) ; sheet U_ultra/US_N
NetJ8_10: J8.10(US_P) ; sheet U_ultra/US_P
NetJ8_11: J8.11(US_N) ; sheet U_ultra/US_N
NetJ8_12: J8.12(US_P) ; sheet U_ultra/US_P
NetJ8_13: J8.13(US_N) ; sheet U_ultra/US_N
NetJ8_14: J8.14(US_P) ; sheet U_ultra/US_P
NetJ8_15: J8.15(US_N) ; sheet U_ultra/US_N
NetJ8_16: J8.16(US_P) ; sheet U_ultra/US_P
NetJ8_17: J8.17(US_N) ; sheet U_ultra/US_N
NetJ8_18: J8.18(US_P) ; sheet U_ultra/US_P
NetJ8_19: J8.19(US_N) ; sheet U_ultra/US_N
NetJ8_20: J8.20(US_P) ; sheet U_ultra/US_P
NetJ8_21: J8.21(US_N) ; sheet U_ultra/US_N
NetJ8_22: J8.22(US_P) ; sheet U_ultra/US_P
NetJ8_23: J8.23(US_N) ; sheet U_ultra/US_N
NetJ8_24: J8.24(US_P) ; sheet U_ultra/US_P
NetJ8_25: J8.25(US_N) ; sheet U_ultra/US_N
NetJ8_26: J8.26(US_P) ; sheet U_ultra/US_P
NetJ8_27: J8.27(US_N) ; sheet U_ultra/US_N
NetJ8_28: J8.28(US_P) ; sheet U_ultra/US_P
NetJ8_29: J8.29(US_N) ; sheet U_ultra/US_N
NetJ8_30: J8.30(US_P) ; sheet U_ultra/US_P
NetJ8_31: J8.31(US_N) ; sheet U_ultra/US_N
NetJ8_32: J8.32(US_P) ; sheet U_ultra/US_P
NetJ8_33: J8.33(US_N) ; sheet U_ultra/US_N
NetJ8_34: J8.34(US_P) ; sheet U_ultra/US_P
NetJ8_35: J8.35(US_N) ; sheet U_ultra/US_N
NetJ8_36: J8.36(US_P) ; sheet U_ultra/US_P
NetJ8_37: J8.37(US_N) ; sheet U_ultra/US_N
NetJ8_38: J8.38(US_P) ; sheet U_ultra/US_P
NetJ8_39: J8.39(US_N) ; sheet U_ultra/US_N
NetJ8_40: J8.40(US_P) ; sheet U_ultra/US_P
NetJ8_41: J8.41(US_N) ; sheet U_ultra/US_N
NetJ8_42: J8.42(US_P) ; sheet U_ultra/US_P
NetJ8_43: J8.43(US_N) ; sheet U_ultra/US_N
NetJ8_44: J8.44(US_P) ; sheet U_ultra/US_P
NetJ8_45: J8.45(US_N) ; sheet U_ultra/US_N
NetJ8_46: J8.46(US_P) ; sheet U_ultra/US_P
NetJ8_47: J8.47(US_N) ; sheet U_ultra/US_N
NetJ8_48: J8.48(US_P) ; sheet U_ultra/US_P
NetJ8_49: J8.49(US_N) ; sheet U_ultra/US_N
NetJ8_50: J8.50(US_P) ; sheet U_ultra/US_P
NetJ8_51: J8.51(US_N) ; sheet U_ultra/US_N
NetJ8_52: J8.52(US_P) ; sheet U_ultra/US_P
NetJ8_53: J8.53(US_N) ; sheet U_ultra/US_N
NetJ8_54: J8.54(US_P) ; sheet U_ultra/US_P
NetJ8_55: J8.55(US_N) ; sheet U_ultra/US_N
NetJ8_56: J8.56(US_P) ; sheet U_ultra/US_P
NetJ8_57: J8.57(US_N) ; sheet U_ultra/US_N
NetJ8_58: J8.58(US_P) ; sheet U_ultra/US_P
NetJ8_59: J8.59(US_N) ; sheet U_ultra/US_N
NetJ8_60: J8.60(US_P) ; sheet U_ultra/US_P
NetJ8_61: J8.61(US_N) ; sheet U_ultra/US_N
NetJ8_62: J8.62(US_P) ; sheet U_ultra/US_P
NetJ8_63: J8.63(US_N) ; sheet U_ultra/US_N
NetJ8_64: J8.64(US_P) ; sheet U_ultra/US_P
NetJ8_65: J8.65(US_N) ; sheet U_ultra/US_N
NetJ8_66: J8.66(US_P) ; sheet U_ultra/US_P
NetJ8_67: J8.67(US_N) ; sheet U_ultra/US_N
NetJ8_68: J8.68(US_P) ; sheet U_ultra/US_P
NetJ8_69: J8.69(US_N) ; sheet U_ultra/US_N
NetJ8_70: J8.70(US_P) ; sheet U_ultra/US_P
NetJ8_71: J8.71(US_N) ; sheet U_ultra/US_N
NetJ8_72: J8.72(US_P) ; sheet U_ultra/US_P
NetJ8_73: J8.73(US_N) ; sheet U_ultra/US_N
NetJ8_74: J8.74(US_P) ; sheet U_ultra/US_P
NetJ8_75: J8.75(US_N) ; sheet U_ultra/US_N
NetJ8_76: J8.76(US_P) ; sheet U_ultra/US_P
NetJ8_77: J8.77(US_N) ; sheet U_ultra/US_N
NetJ8_78: J8.78(US_P) ; sheet U_ultra/US_P
NetJ8_79: J8.79(US_N) ; sheet U_ultra/US_N
NetJ8_80: J8.80(US_P) ; sheet U_ultra/US_P
NetJ8_81: J8.81(US_N) ; sheet U_ultra/US_N
NetJ8_82: J8.82(US_P) ; sheet U_ultra/US_P
NetJ8_83: J8.83(US_N) ; sheet U_ultra/US_N
NetJ8_84: J8.84(US_P) ; sheet U_ultra/US_P
NetJ8_85: J8.85(US_N) ; sheet U_ultra/US_N
NetJ8_86: J8.86(US_P) ; sheet U_ultra/US_P
NetJ8_87: J8.87(US_N) ; sheet U_ultra/US_N
NetJ8_88: J8.88(US_P) ; sheet U_ultra/US_P
NetJ8_89: J8.89(US_N) ; sheet U_ultra/US_N
NetJ8_90: J8.90(US_P) ; sheet U_ultra/US_P
NetJ8_91: J8.91(US_N) ; sheet U_ultra/US_N
NetJ8_92: J8.92(US_P) ; sheet U_ultra/US_P
NetJ8_93: J8.93(US_N) ; sheet U_ultra/US_N
NetJ8_94: J8.94(US_P) ; sheet U_ultra/US_P
NetJ8_95: J8.95(US_N) ; sheet U_ultra/US_N
NetJ8_96: J8.96(US_P) ; sheet U_ultra/US_P

## Library data of the parts
C1-C8 = C-0805-10u-25V: 3; Supplier 1: Mouser; Supplier Part Number 1: 80-C0805C106K3P
J1-J8 = PIN_HEADER_1.27_2x50